# EasyEDA Pro project 3SE_24_Power_Rune.eprj, board 深大PCB参考 (continued)
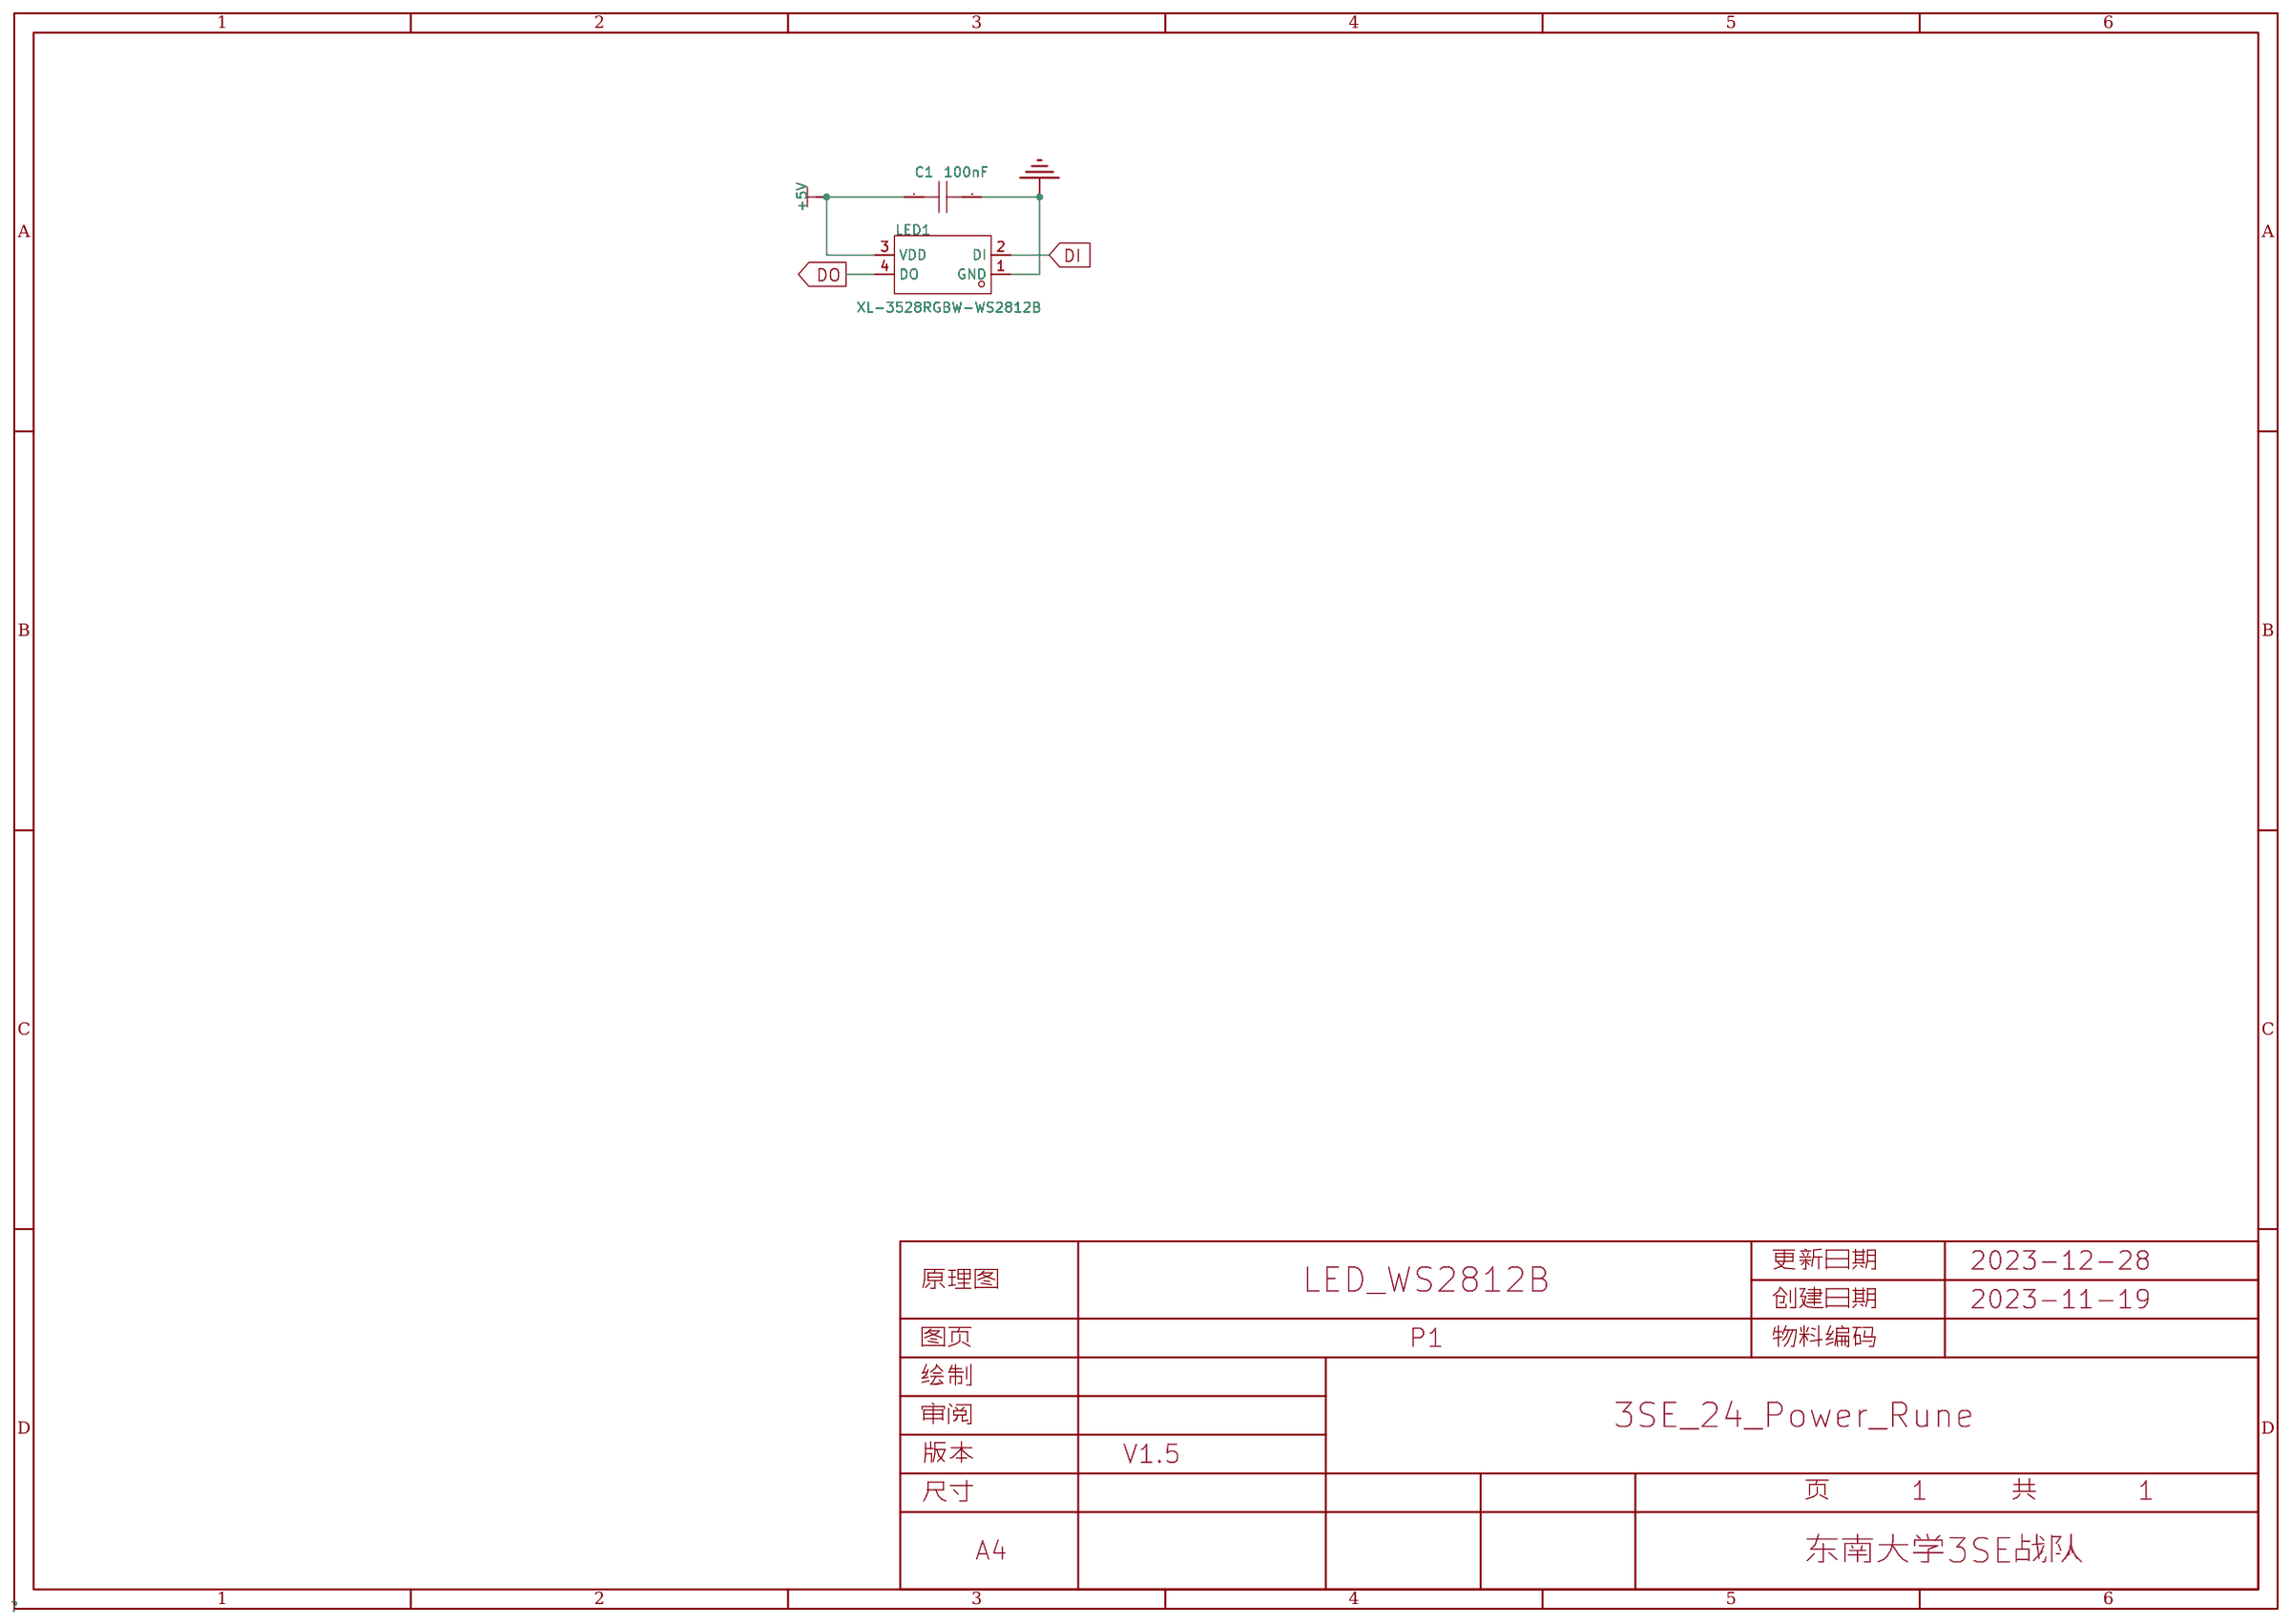
[diagram p0: schematic sheet]
## Routing (per net, layer and track width the routed paths; a pad name or vN(x,y) marks a point on that pad's centre or on a via; arc(x,y) is an arc through that point) (continued)
DIN1: length 17.4
  Bottom Layer w0.381: v1(19.43,252.35) 27.17,237.46 J1.1
DIN2: length 14.7
  Bottom Layer w0.381: J2.1 28.64,151.46 v1(30.61,137.54)
DIN3: length 7.7
  Bottom Layer w0.381: v2(40.39,194.69) 33.5,193.27 J3.1
I: length 13.6
  Top Layer w0.381: D356.2 143.8,117.85 156.07,117.34 D357.4
NETD1_2: length 8.2
  Top Layer w0.254: 30.62,248.61 30.62,249 arc(30.43,249.97) 29.88,250.79 27.59,253.08 arc(26.77,253.63) 25.79,253.82 D1.2
NETD2_2: length 20.5
  Top Layer w0.254: D3.4 36.29,250.2 arc(36.34,250.13) D2.2
NETD3_2: length 9.2
  Top Layer w0.254: D4.4 29.6,265.27 arc(28.78,265.82) 27.8,266.02 D3.2
NETD4_2: length 23
  Top Layer w0.254: 40.18,261.7 D4.2 arc(40.24,262.14) 39.99,262.51 D5.4
NETD5_2: length 10.6
  Top Layer w0.254: D6.4 31.19,279.05 arc(30.74,279.35) D5.2
NETD6_2: length 23.6
  Top Layer w0.254: D6.2 27.56,289.84 arc(27.32,290.2) D7.4
NETD7_2: length 11.4
  Top Layer w0.254: D7.2 33.9,292.05 arc(34.87,291.86) 35.7,291.31 D8.4
NETD8_2: length 25.1
  Top Layer w0.254: D8.2 47.44,286.99 arc(47.25,287.96) 46.7,288.79 D9.4
NETD9_2: length 10.1
  Top Layer w0.254: D10.4 37.58,305.8 arc(37,306.19) D9.2
NETD10_2: length 26
  Top Layer w0.254: D11.4 34.09,317.5 arc(34.29,316.53) 34.84,315.71 D10.2
NETD11_2: length 10.5
  Top Layer w0.254: D12.4 46.08,312.99 arc(45.89,313.96) 45.34,314.78 39.97,320.16
NETD12_2: length 35.5
  Top Layer w0.381: D12.2 51.73,312.07 36.47,342.72 D13.4
NETD13_2: length 7.2
  Top Layer w0.381: D14.4 43.07,335.4 arc(43.62,336.22) 43.81,337.19 43.81,338.88 arc(43.62,339.85) 43.07,340.67 42.02,341.72
NETD14_2: length 8.7
  Top Layer w0.381: D15.4 49.67,326.25 arc(50.23,327.08) 50.42,328.05 50.42,330.92 arc(50.23,331.89) 49.67,332.71 D14.2
NETD15_2: length 27
  Top Layer w0.381: D16.4 53.52,350.61 54.91,324.93 D15.2
NETD16_2: length 7.6
  Top Layer w0.508: 58.7,340.19 58.76,340.74 58.66,345.08 arc(58.65,345.11) 58.65,345.14 58.33,347.22 D16.2
NETD17_2: length 8.3
  Top Layer w0.381: 63.02,329.02 63.52,329.52 arc(64.07,330.34) 64.26,331.31 64.26,334.88 arc(64.07,335.85) 63.52,336.67 D17.2
NETD18_2: length 30.6
  Top Layer w0.254: D18.2 67.93,326.25 66.44,355.36 D19.4
NETD19_2: length 8.8
  Top Layer w0.381: D20.4 71.9,345.27 arc(72.45,346.09) 72.64,347.06 72.64,350.25 arc(72.45,351.22) 71.9,352.04 D19.2
NETD20_2: length 8.4
  Top Layer w0.381: D21.4 76.22,334.98 arc(76.77,335.8) 76.96,336.78 76.96,339.2 arc(76.77,340.17) 76.22,340.99 D20.2
NETD21_2: length 30.3
  Top Layer w0.381: D21.2 79.83,330.87 78.66,359.88 78.76,360.51
NETD22_2: length 8.2
  Top Layer w0.381: D22.2 83.73,356.85 arc(84.27,356.05) 84.45,355.09 84.45,351.12 arc(84.26,350.15) 83.72,349.34
NETD23_2: length 7.9
  Top Layer w0.381: D23.2 88.69,345.67 arc(89.24,344.84) 89.43,343.87 D24.4
NETD24_2: length 30.3
  Top Layer w0.381: 94,365.09 93.91,364.45 94.31,335.44 D24.2
NETD25_2: length 9.8
  Top Layer w0.381: D25.2 98.95,361.44 arc(99.5,360.62) 99.69,359.64 99.69,354.94 arc(99.5,353.96) 98.95,353.14 D26.4
NETD26_2: length 7.5
  Top Layer w0.381: D26.2 arc(103.49,348.45) 103.63,347.75 103.63,345.6 arc(103.44,344.63) 102.89,343.81 102.81,343.73 arc(102.31,342.98) D27.4
NETD27_2: length 30.1
  Top Layer w0.381: D27.2 107.01,339.25 107.65,368.1 107.75,368.73
NETD28_2: length 9.5
  Top Layer w0.381: D29.4 112.54,357.59 arc(113.09,358.41) 113.28,359.38 113.28,363.44 arc(113.09,364.41) 112.54,365.23 D28.2
NETD29_2: length 8.2
  Top Layer w0.381: D29.2 116.35,353.06 arc(116.9,352.23) 117.09,351.26 117.09,348.78 arc(116.9,347.81) 116.35,346.98 116.09,346.72 arc(115.72,346.17) D30.4
NETD30_2: length 30.5
  Top Layer w0.381: 120.37,342.05 120.47,342.68 118.42,371.82 D31.4
NETD31_2: length 8.6
  Top Layer w0.381: D32.4 123.72,361.65 arc(124.27,362.47) 124.46,363.45 124.46,366.76 arc(124.27,367.73) 123.72,368.55 123.29,368.98
NETD32_2: length 7.9
  Top Layer w0.254: D32.2 128.45,357.18 arc(128.79,356.49) 128.91,355.73 128.91,353.48 arc(128.71,352.51) 128.16,351.68 127.72,351.24 arc(127.49,350.89) D33.4
NETD33_2: length 29
  Top Layer w0.254: D34.4 130.44,375.17 132.32,347.72 D33.2
NETD34_2: length 8.7
  Top Layer w0.381: 134.64,364.58 134.64,364.61 arc(134.84,365.58) 135.39,366.4 135.78,366.79 arc(136.33,367.62) 136.53,368.59 136.53,369.58 ; D34.2 135.75,371.95 arc(136.33,370.83) 136.53,369.59
NETD35_2: length 8.4
  Top Layer w0.381: D36.4 138.2,353.68 arc(138.39,354.66) 138.94,355.48 139.67,356.2 arc(140.07,356.8) 140.21,357.5 140.21,358.82 arc(140.02,359.83) 139.49,360.7 arc(139.4,360.89) 139.42,361.1 ; 139.42,361.1 D35.2
NETD36_2: length 27.6
  Top Layer w0.381: D37.4 148.25,376.49 143.08,350.68 D36.2
NETD37_2: length 7
  Top Layer w0.381: D38.4 151.48,368.23 arc(152.03,369.06) 152.23,370.03 D37.2
NETD38_2: length 7.1
  Top Layer w0.381: D38.2 153.37,359.14 arc(153.18,358.17) 152.62,357.35 151.38,356.11 arc(151.11,355.93) 150.8,355.87
NETD39_2: length 27.8
  Top Layer w0.254: 154.51,351.27 154.83,351.92 164.95,377.01
NETD40_2: length 6.8
  Top Layer w0.381: D40.2 168.02,371.04 arc(167.83,370.07) 167.28,369.24 D41.4
NETD41_2: length 7.7
  Top Layer w0.381: D41.2 168.02,360.21 arc(167.83,359.24) 167.28,358.41 164.4,355.54 arc(164.37,355.52) D42.4
NETD42_2: length 28.5
  Top Layer w0.381: D42.2 167.95,351.17 177.62,376.67 D43.4
NETD43_2: length 7.7
  Top Layer w0.381: D43.2 181.23,370.37 arc(181.03,369.4) 180.48,368.57 178.39,366.47 arc(178.06,366.25) D44.4
NETD44_2: length 7.8
  Top Layer w0.381: D44.2 180.97,359.48 arc(180.78,358.51) 180.23,357.69 177.42,354.88
NETD45_2: length 29.7
  Top Layer w0.381: D46.4 191.72,376.92 181.03,350.53 D45.2
NETD46_2: length 7.5
  Top Layer w0.381: D47.4 194.58,369.12 arc(195.13,369.94) 195.32,370.91 D46.2
NETD47_2: length 7.8
  Top Layer w0.381: D47.2 195.2,359.35 arc(195,358.38) 194.45,357.56 D48.4
NETD48_2: length 29.3
  Top Layer w0.381: D49.4 204.8,377.09 195.51,350.66 D48.2
NETD49_2: length 7.4
  Top Layer w0.381: 208.4,372.75 208.4,370.91 arc(208.21,369.94) 207.66,369.11 D50.4
NETD50_2: length 7.4
  Top Layer w0.381: D50.2 208.41,359.19 arc(208.21,358.22) 207.66,357.39 D51.4
NETD51_2: length 29
  Top Layer w0.381: D51.2 209.22,351.01 218.64,377.09 D52.4
NETD52_2: length 6.3
  Top Layer w0.381: D53.4 221.5,369.75 arc(222.05,370.57) 222.25,371.55 D52.2
NETD53_2: length 8.8
  Top Layer w0.381: D54.4 221.89,358.45 arc(222.44,359.27) 222.63,360.24 D53.2
NETD54_2: length 30.3
  Top Layer w0.381: D55.4 238.71,375.06 222.43,351.04 D54.2
NETD55_2: length 7.5
  Top Layer w0.381: D55.2 arc(240.48,369.07) 240.09,368.49 237.22,365.62 arc(236.39,365.06) 235.42,364.87
NETD56_2: length 8.8
  Top Layer w0.381: D57.4 236.38,357.45 arc(236.88,358.2) D56.2
NETD57_2: length 32.1
  Top Layer w0.381: 232.89,346.8 233.38,347.22 252.93,371 D58.4
NETD58_2: length 8.3
  Top Layer w0.381: D59.4 250.1,360.5 arc(251.07,360.69) 251.9,361.24 254.1,363.44 arc(254.65,364.27) 254.84,365.24 D58.2
NETD59_2: length 9.4
  Top Layer w0.381: D60.4 245.27,349.07 arc(246.25,349.26) 247.07,349.81 250.03,352.77 arc(250.58,353.6) 250.78,354.57 D59.2
NETD60_2: length 31.6
  Top Layer w0.381: D61.4 265.89,366.81 246.18,343.76 D60.2
NETD61_2: length 8.7
  Top Layer w0.381: D61.2 267.79,361.3 arc(267.6,360.33) 267.05,359.51 264.21,356.67 arc(263.39,356.12) 262.42,355.93 D62.4
NETD62_2: length 9.6
  Top Layer w0.381: D63.4 257.97,344.24 arc(258.95,344.44) 259.77,344.99 262.6,347.82 arc(263.16,348.65) 263.35,349.62 D62.2
NETD63_2: length 32.8
  Top Layer w0.381: D63.2 258.88,338.93 280.09,362.2 D64.4
NETD64_2: length 9.3
  Top Layer w0.381: D65.4 275.47,351.35 arc(275.53,351.36) 275.59,351.38 arc(278.82,352.94) 281.62,355.17 arc(281.9,355.58) 281.99,356.07 281.99,356.88
NETD65_2: length 9.7
  Top Layer w0.381: D66.4 271.56,339.67 arc(272.53,339.86) 273.36,340.41 275.94,343 arc(276.49,343.82) 276.68,344.79 D65.2
NETD66_2: length 32.5
  Top Layer w0.381: 293.21,358.29 292.73,357.87 272.21,334.36 D66.2
NETD67_2: length 8.6
  Top Layer w0.381: D68.4 289.34,347.42 arc(290.31,347.61) 291.14,348.16 294.01,351.03 arc(294.48,351.73) D67.2
NETD68_2: length 10
  Top Layer w0.381: D69.4 284.48,335.31 arc(285.45,335.51) 286.27,336.06 288.47,338.25 arc(289.4,339.56) 289.86,341.1 D68.2
NETD69_2: length 32.2
  Top Layer w0.381: D69.2 285.27,330 305.38,353.47 D70.4
NETD70_2: length 8.4
  Top Layer w0.381: D70.2 307.29,347.84 arc(307.1,346.87) 306.55,346.04 304.22,343.72 arc(303.4,343.17) 302.42,342.97 D71.4
NETD71_2: length 9
  Top Layer w0.381: D71.2 303.1,336.92 arc(302.91,335.95) 302.36,335.12 299,331.77 arc(298.19,331.23) D72.4
NETD72_2: length 31
  Top Layer w0.381: D73.4 317.32,349.28 299.14,325.72 D72.2
NETD73_2: length 8.1
  Top Layer w0.381: D74.4 314.62,338.91 arc(315.59,339.1) 316.41,339.65 318.48,341.73 arc(319.04,342.55) 319.23,343.52 D73.2
NETD74_2: length 7.5
  Top Layer w0.381: D75.4 310.93,328.75 arc(311.9,328.94) 312.73,329.49 314.55,331.31 arc(315.1,332.14) 315.29,333.11 D74.2
NETD75_2: length 29.7
  Top Layer w0.381: D76.4 334.91,340.2 311.96,323.44 D75.2
NETD76_2: length 9.3
  Top Layer w0.381: D77.4 330.23,330.65 arc(331.21,330.84) 332.03,331.4 334.67,334.04 arc(334.83,334.28) D76.2
NETD77_2: length 10.5
  Top Layer w0.381: D78.4 320.91,320.11 arc(321.89,320.3) 322.71,320.85 326.63,324.78
NETD78_2: length 21
  Top Layer w0.381: 317.36,314.24 317.96,314.47 337.12,318.95 337.75,319.07
NETD79_2: length 12.8
  Top Layer w0.381: D80.4 331.51,309.84 arc(332.49,310.04) 333.31,310.59 336.12,313.39
NETD80_2: length 19.7
  Top Layer w0.381: D80.2 323.72,304.29 341.59,299.92 D81.4
NETD81_2: length 11.5
  Top Layer w0.381: 338.75,295.05 338.2,294.5 arc(337.37,293.94) 336.4,293.75 330.04,293.75 arc(329.07,293.94) 328.25,294.5 D82.4
NETD82_2: length 19.9
  Top Layer w0.381: 343.93,285.55 343.3,285.65 325.16,289.87 324.52,289.97
NETD83_2: length 10.4
  Top Layer w0.381: D84.4 332.57,280.53 arc(333.39,279.97) 334.36,279.78 338.41,279.78 arc(339.38,279.97) 340.21,280.53 D83.2
NETD84_2: length 19.9
  Top Layer w0.381: D85.4 345.97,271.04 328.33,277.04 D84.2
NETD85_2: length 10.7
  Top Layer w0.381: 343.12,266.17 343,266.05 arc(342.18,265.5) 341.21,265.3 336.14,265.3 arc(335.17,265.5) 334.34,266.05 333.33,267.06
NETD86_2: length 20.2
  Top Layer w0.381: D86.2 330.49,262.18 348.58,256.74 D87.4
NETD87_2: length 9.4
  Top Layer w0.381: D87.2 345.31,251.44 arc(344.49,250.89) 343.51,250.7 339.57,250.7 arc(338.6,250.89) 337.77,251.44 D88.4
NETD89_2: length 14
  Top Layer w0.381: D89.2 26.18,131.83 14.65,131.83 13.91,132.56 13.8,132.56
NETD90_2: length 24.2
  Top Layer w0.381: D90.2 10.41,127.87 30.91,127.87 33.34,125.45 D91.4
NETD91_2: length 13.8
  Top Layer w0.381: D91.2 27.89,118.55 arc(27.62,118.31) 27.31,118.11 arc(27.03,117.99) 26.75,117.89 arc(26.43,117.83) 26.1,117.81 17.32,117.81
NETD92_2: length 22.7
  Top Layer w0.381: D93.4 35.73,112.49 35.1,113.12 13.93,113.12 D92.2
NETD93_2: length 16.7
  Top Layer w0.381: 32.81,107.71 30.59,105.49 arc(29.77,104.94) 28.79,104.75 D94.4
NETD94_2: length 28.2
  Top Layer w0.381: D94.2 40.74,99.97 arc(41.32,99.86) 41.82,99.53
NETD95_2: length 10
  Top Layer w0.508: D96.4 28.96,95.16 35.62,94.55 arc(35.67,94.54) 35.72,94.55 37.79,94.81 D95.2
NETD96_2: length 10
  Top Layer w0.381: D97.4 23.28,89.76 arc(24.17,89.94) D96.2
NETD97_2: length 34.1
  Top Layer w0.381: 11.6,84.99 12.23,84.89 44.98,87.48 D98.4
NETD98_2: length 12
  Top Layer w0.381: D98.2 42.22,81.38 arc(41.4,80.83) 40.42,80.63 D99.4
NETD99_2: length 12.5
  Top Layer w0.381: D100.4 26.14,73.52 arc(27.11,73.71) 27.93,74.26 D99.2
NETD100_2: length 37.6
  Top Layer w0.381: 51.46,74.21 50.82,74.19 15.22,68.22 D100.2 14.79,68.21
NETD101_2: length 9.7
  Top Layer w0.381: D102.4 46.98,68.06 arc(47.95,68.25) 48.77,68.8 D101.2
NETD102_2: length 10.2
  Top Layer w0.381: 27.33,60.69 33.69,60.69 arc(34.67,60.89) 35.49,61.44 36.8,62.75
NETD103_2: length 10.8
  Top Layer w0.381: D103.2 23.04,53.69 arc(22.22,53.14) 21.25,52.95 D104.4
NETD104_2: length 44.5
  Top Layer w0.381: 54.54,61.64 53.91,61.52 12.93,47.65 D104.2
NETD105_2: length 11.3
  Top Layer w0.381: 43.36,51.54 47.43,51.54 arc(48.41,51.74) 49.23,52.29 D105.2
NETD106_2: length 11.3
  Top Layer w0.381: D106.2 38.05,42.19 arc(37.23,41.64) 36.26,41.45 32.19,41.45
NETD107_2: length 38.2
  Top Layer w0.381: D108.4 64.34,52.23 31.18,35.89 D107.2
NETD108_2: length 6.4
  Top Layer w0.381: D109.4 62.52,43.25 arc(63.49,43.45) 64.32,44 65.54,45.22 arc(66.06,46) D108.2
NETD109_2: length 8.2
  Top Layer w0.381: D110.4 58.46,32.46 arc(59.43,32.65) 60.25,33.2 62.45,35.4 arc(63,36.23) 63.2,37.2 D109.2
NETD110_2: length 30.3
  Top Layer w0.381: D110.2 59.61,27.14 77.47,50.02 D111.4
NETD111_2: length 8.2
  Top Layer w0.381: D112.4 74.46,39.06 arc(75.43,39.25) 76.25,39.81 78.63,42.18 arc(79.18,43.01) 79.38,43.98 D111.2
NETD112_2: length 7.5
  Top Layer w0.381: D113.4 71.54,28.77 arc(72.51,28.97) 73.33,29.52 75.03,31.21 arc(75.58,32.03) 75.77,33.01 D112.2
NETD113_2: length 31
  Top Layer w0.381: D114.4 91.39,46.52 72.7,23.46 D113.2
NETD114_2: length 8.5
  Top Layer w0.381: D115.4 92.55,38.73 arc(93.1,39.55) 93.3,40.52 D114.2
NETD115_2: length 7.7
  Top Layer w0.381: D116.4 85.89,24.84 arc(86.86,25.03) 87.68,25.58 89.12,27.02 arc(89.67,27.84) 89.87,28.82 D115.2
NETD116_2: length 34.1
  Top Layer w0.381: D117.4 107.42,44.55 86.16,19.52 D116.2
NETD117_2: length 9.1
  Top Layer w0.381: 109.33,39.24 109.33,38.52 arc(109.14,37.55) 108.59,36.73 D118.4
NETD118_2: length 8.4
  Top Layer w0.381: D119.4 100.75,21.41 arc(101.72,21.6) 102.54,22.15 104.74,24.35 arc(105.29,25.18) 105.49,26.15 D118.2
NETD119_2: length 33
  Top Layer w0.381: D120.4 123.01,39.53 101.65,16.1 D119.2
NETD120_2: length 9.1
  Top Layer w0.381: D120.2 124.92,33.51 arc(124.73,32.54) 124.17,31.72 121.59,29.14 arc(120.77,28.59) 119.8,28.39 D121.4
NETD121_2: length 8.1
  Top Layer w0.381: D121.2 120.47,22.47 arc(120.28,21.49) 119.73,20.67 118.04,18.98 arc(117.21,18.43) 116.24,18.23 D122.4
NETD122_2: length 31.7
  Top Layer w0.381: D122.2 116.64,12.92 135.58,36.74 D123.4
NETD123_2: length 8
  Top Layer w0.381: D123.2 137.49,31.38 arc(137.3,30.41) 136.75,29.58 D124.4
NETD124_2: length 7.9
  Top Layer w0.381: D124.2 arc(133.75,18.7) 133.23,17.92 130.04,14.73 arc(129.43,14.31) D125.4
NETD125_2: length 32.2
  Top Layer w0.381: D126.4 148.79,33.82 130.61,8.86 D125.2
NETD126_2: length 8
  Top Layer w0.381: D127.4 146.47,23.44 arc(147.44,23.63) 148.26,24.18 149.37,25.29 arc(150.23,26.5) 150.66,27.92 D126.2
NETD127_2: length 7.5
  Top Layer w0.381: D127.2 147.02,17.28 arc(146.82,16.31) 146.27,15.49 D128.4
NETD128_2: length 31.6
  Top Layer w0.381: D128.2 144.58,6.57 146.33,9.69 arc(146.33,9.7) 146.34,9.71 158.06,33.77 D129.4
NETD129_2: length 7.5
  Top Layer w0.381: D129.2 161.67,26.5 arc(161.48,25.52) 160.93,24.7 D130.4
NETD130_2: length 8.8
  Top Layer w0.381: D130.2 162.42,16.03 arc(162.23,15.06) 161.68,14.23 159.41,11.97 arc(158.72,11.5) D131.4
NETD131_2: length 30.4
  Top Layer w0.381: D131.2 161.51,7 172.81,33.89 D132.4
NETD132_2: length 7.8
  Top Layer w0.381: D132.2 176.42,27.06 arc(176.22,26.09) 175.67,25.27 D133.4
NETD133_2: length 8.3
  Top Layer w0.381: D133.2 176.6,16.5 arc(176.41,15.53) 175.86,14.71 D134.4
NETD134_2: length 30.1
  Top Layer w0.381: D135.4 186.58,33.89 176.1,7 D134.2
NETD135_2: length 7.7
  Top Layer w0.381: D136.4 189.45,24.86 arc(190,25.69) 190.19,26.66 D135.2
NETD136_2: length 8.1
  Top Layer w0.381: D136.2 190.78,16.1 arc(190.59,15.13) 190.04,14.3 D137.4
NETD137_2: length 30.2
  Top Layer w0.381: D137.2 190.68,7 201.35,33.89 D138.4
NETD138_2: length 7.9
  Top Layer w0.381: D139.4 204.22,25.45 arc(204.77,26.28) 204.96,27.25 D138.2
NETD139_2: length 7.9
  Top Layer w0.381: D139.2 204.96,15.69 arc(204.77,14.72) 204.22,13.9 D140.4
NETD140_2: length 30.4
  Top Layer w0.381: D141.4 213.81,34.89 205.27,7 D140.2
NETD141_2: length 7.8
  Top Layer w0.381: 216.77,23.57 216.98,24.18 217.78,28.49 arc(217.78,28.51) 217.79,28.54 217.91,30.64 D141.2
NETD142_2: length 8
  Top Layer w0.381: D143.4 219.01,12.26 220.56,16.36 arc(220.57,16.42) 220.58,16.48 220.66,18.72 D142.2
NETD143_2: length 30.9
  Top Layer w0.381: D144.4 227.42,37.34 223.11,8 D143.2
NETD144_2: length 7.9
  Top Layer w0.381: D145.4 231.03,26.48 231.5,30.93 arc(231.5,30.95) 231.5,30.97 231.52,33.08 D144.2
NETD145_2: length 7.7
  Top Layer w0.381: D145.2 234.72,21.02 234.68,18.9 arc(234.68,18.87) 234.67,18.84 233.87,14.67 D146.4
NETD146_2: length 31.1
  Top Layer w0.381: D146.2 237.97,10.42 241.02,40.13 D147.4
NETD147_2: length 8.1
  Top Layer w0.381: D147.2 245.12,35.88 245.09,29.02 244.88,28.42
NETD148_2: length 8
  Top Layer w0.381: D148.2 248.78,23.56 248.65,21.43 arc(248.65,21.41) 248.64,21.39 247.91,16.92 D149.4
NETD149_2: length 31.1
  Top Layer w0.381: 251.8,12.07 252.01,12.67 254.62,42.42 254.83,43.02
NETD150_2: length 8.2
  Top Layer w0.381: D151.4 258.19,31.48 arc(258.74,32.3) 258.93,33.28 D150.2
NETD151_2: length 7.9
  Top Layer w0.381: D151.2 261.56,26.1 261.56,19.5 D152.4
NETD152_2: length 31.2
  Top Layer w0.381: D153.4 268.23,45.08 265.66,15.24 D152.2
NETD153_2: length 7.8
  Top Layer w0.381: D154.4 273.2,34.35 272.33,40.83 D153.2
NETD154_2: length 8
  Top Layer w0.381: D155.4 276.35,22.85 arc(276.9,23.67) 277.1,24.64 D154.2
NETD155_2: length 30.2
  Top Layer w0.381: D155.2 279.88,18.42 281.1,47.33 D156.4
NETD156_2: length 8.4
  Top Layer w0.381: 286.71,36.22 286.81,36.85 286.26,41.68 arc(286.26,41.69) 286.26,41.7 285.88,43.86 D156.2
NETD157_2: length 7.1
  Top Layer w0.381: D158.4 292.51,30.67 arc(292.31,31.65) 291.76,32.47 D157.2
NETD158_2: length 28.4
  Top Layer w0.381: 297.28,22.52 297.38,23.15 295.96,50.26 D159.4
NETD159_2: length 7.7
  Top Layer w0.381: D160.4 301.46,45.91 arc(301.3,46.72) 300.84,47.41
NETD160_2: length 7.7
  Top Layer w0.381: 306.86,28.79 306.86,34.86 arc(306.7,35.67) D160.2
NETD161_2: length 28.6
  Top Layer w0.381: D161.2 311.73,25.94 309.2,53.18 D162.4
NETD162_2: length 11.2
  Top Layer w0.381: D163.4 319.9,47.06 arc(319.7,48.03) 319.15,48.85 D162.2
NETD163_2: length 10.5
  Top Layer w0.381: D163.2 330.2,38.92 arc(330.75,38.1) 330.95,37.13 D164.4
NETD164_2: length 37.7
  Top Layer w0.381: D164.2 336.59,34.83 315.94,64.87 D165.4
NETD165_2: length 11.6
  Top Layer w0.381: D165.2 322.32,66.78 arc(323.29,66.58) 324.11,66.03 327.73,62.41 arc(328.28,61.59) 328.48,60.62 D166.4
NETD166_2: length 10.7
  Top Layer w0.381: D167.4 341.18,53.25 arc(340.98,54.22) 340.43,55.05 335.37,60.11 arc(334.84,60.46) 334.21,60.59
NETD167_2: length 10.6
  Top Layer w0.381: 346.91,54.4 347.39,54.4 arc(348.13,54.25) 348.76,53.83 351.43,51.16 arc(352.7,49.31) 353.23,47.12 D168.4
NETD168_2: length 49.2
  Top Layer w0.381: D169.4 322.04,79.76 358.55,48.69 D168.2
NETD169_2: length 11.9
  Top Layer w0.381: D169.2 328.05,81.67 arc(329.02,81.47) 329.85,80.92 D170.4
NETD170_2: length 13.1
  Top Layer w0.381: D171.4 351.08,67.35 arc(350.89,68.32) 350.34,69.14 344.38,75.1 arc(343.56,75.65) 342.59,75.84 D170.2
NETD171_2: length 40.5
  Top Layer w0.381: 325.92,94.75 326.34,94.27 356.4,69.09 D171.2
NETD172_2: length 10.3
  Top Layer w0.381: D172.2 331.78,96.17 arc(332.75,95.98) 333.58,95.43 338.74,90.27 arc(338.99,89.9) 339.07,89.46
NETD173_2: length 9.7
  Top Layer w0.381: D173.2 345.33,90.88 arc(346.3,90.69) 347.12,90.14 D174.4
NETD174_2: length 35.3
  Top Layer w0.381: 357.96,86.46 357.54,86.95 331.24,108.46 D175.4
NETD175_2: length 16.9
  Top Layer w0.381: 336.55,110.36 339.64,110.36 arc(340.61,110.17) 341.44,109.62 D176.4
NETD176_2: length 29.4
  Top Layer w0.381: D176.2 335.74,122.47 arc(335.35,123.06) D177.4
NETD177_2: length 11.4
  Top Layer w0.381: D177.2 342.09,125.19 arc(343.06,125) 343.88,124.45 D178.4
NETD178_2: length 24.4
  Top Layer w0.381: D179.4 340.16,136.38 arc(340.35,135.41) 340.9,134.58 355.47,120.02
NETD179_2: length 8.4
  Top Layer w0.381: D179.2 346.98,139.65 arc(347.95,139.46) 348.77,138.91 350.85,136.83 arc(351.4,136.01) 351.59,135.04 D180.4
NETD181_2: length 13.9
  Top Layer w0.381: 43.69,189.83 43.69,178.18 45.12,176.75 45.33,176.75
NETD182_2: length 17.7
  Top Layer w0.381: D182.2 40.51,172.49 40.51,155.42 D183.4
NETD183_2: length 11.2
  Top Layer w0.381: D184.4 49.45,143.93 arc(49.26,144.9) 48.71,145.73 45.77,148.67 arc(45.22,149.49) 45.03,150.46 45.03,151.48
NETD184_2: length 14.1
  Top Layer w0.381: 60.5,126.77 D185.4 ; 54.33,138.55 54.33,138.24 arc(54.52,137.27) 55.07,136.45 57.17,134.34 arc(59.42,131.03) 60.27,127.11 arc(60.33,126.91) 60.5,126.77
NETD185_2: length 16.4
  Top Layer w0.381: D185.2 58.75,121.39 69.85,111.15 70.48,111.23
NETD186_2: length 13.7
  Top Layer w0.381: 68.46,105.68 69.09,105.76 79.92,99.62 80.54,99.78
NETD187_2: length 20
  Top Layer w0.381: D187.2 79.03,93.41 79.27,89.94 79.28,89.8 79.39,89.69 82.98,86.42 83.11,86.4 93.05,85.52 D188.4
NETD188_2: length 15.8
  Top Layer w0.381: 107.36,75.16 107.59,75.16 107.17,74.92 93.68,80.11 D188.2
NETD189_2: length 15.7
  Top Layer w0.381: D190.4 122.47,66.15 108.44,69.61 D189.2
NETD190_2: length 18.5
  Top Layer w0.381: D190.2 140.82,60.68 arc(141.56,60.54) 142.19,60.12
NETD191_2: length 16.5
  Top Layer w0.381: D191.2 159.41,54.44 arc(159.87,54.53) D192.4
NETD192_2: length 20.8
  Top Layer w0.381: D192.2 162.99,49.85 182.44,51.55 D193.4
NETD193_2: length 11.8
  Top Layer w0.381: D193.2 186.36,47.77 196.17,51.67 D194.4
NETD194_2: length 11.2
  Top Layer w0.381: D194.2 200.32,48.15 208.43,53.82 D195.4
NETD195_2: length 9
  Top Layer w0.381: D196.4 220.96,50.12 213.2,49.74 212.79,50.24
NETD196_2: length 19.9
  Top Layer w0.381: 242.15,64.78 242.11,64.14 225.92,54.87 225.46,54.43
NETD197_2: length 15.7
  Top Layer w0.381: D198.4 257.68,72.43 247.26,62.39 D197.2
NETD198_2: length 15.7
  Top Layer w0.381: D198.2 263.02,71.34 272.15,82.52 D199.4
NETD199_2: length 21.1
  Top Layer w0.381: D200.4 285.85,98.61 285.7,98.6 285.59,98.49 281.18,93.79 281.15,93.73 277.23,84.1 277.23,83.99 277.24,83.95 D199.2
NETD200_2: length 14.5
  Top Layer w0.381: D200.2 292.66,98.31 298.31,110.27 D201.4
NETD201_2: length 15.4
  Top Layer w0.381: D202.4 306.77,125.03 303.67,111.22 D201.2
NETD202_2: length 13.3
  Top Layer w0.381: 312.31,126.1 311.97,126.64 314.26,138.45 313.85,138.94
NETD203_2: length 15.6
  Top Layer w0.381: D204.4 319.91,155.05 319.22,140.7 D203.2
NETD204_2: length 15.7
  Top Layer w0.381: 322.99,172.7 323.5,172.32 324.54,157.9 D204.2
NETD205_2: length 16
  Top Layer w0.381: 324.57,190.5 325.13,190.19 327.75,175.74 D205.2
NETD206_2: length 15.5
  Top Layer w0.381: D207.4 324.09,207.54 328.92,194.11 D206.2
NETD207_2: length 18
  Top Layer w0.381: D208.4 327.45,228.71 328.46,212.04 327.95,211.66
NETD208_2: length 12.4
  Top Layer w0.381: D209.4 315.91,241.79 320.7,238.69 arc(320.79,238.61) 320.85,238.51 ; 320.85,238.51 322.7,233.67 D208.2
NETD209_2: length 15.7
  Top Layer w0.381: D210.4 308.66,257.88 317.98,246.83 D209.2
NETD210_2: length 15.7
  Top Layer w0.381: D210.2 310.09,263.14 299.46,272.94 D211.4
NETD211_2: length 12.1
  Top Layer w0.381: D211.2 300.21,278.33 291.48,284.71 290.87,284.55
NETD212_2: length 21.6
  Top Layer w0.381: D212.2 292.37,290.92 288.88,296.56 288.86,296.6 288.81,296.66 286.62,298.24 286.51,298.25 275.78,299.01 D213.4
NETD213_2: length 15.7
  Top Layer w0.381: 275.77,304.66 275.17,304.43 261.68,309.62 D214.4
NETD214_2: length 15.7
  Top Layer w0.381: D214.2 260.4,314.92 246.36,318.38 245.85,318.01
NETD215_2: length 15.7
  Top Layer w0.381: D216.4 230.07,325.15 244.43,323.47 D215.2
NETD216_2: length 15.7
  Top Layer w0.381: D216.2 227.51,329.96 213.05,329.83 212.64,329.33
NETD217_2: length 11.5
  Top Layer w0.381: D218.4 199.96,331.87 209.91,334.27 210.32,334.76
NETD218_2: length 11.5
  Top Layer w0.381: D218.2 196.28,335.89 186.36,333.26 D219.4
NETD219_2: length 19.5
  Top Layer w0.381: D219.2 182.44,337.04 165.23,331.22 D220.4
NETD220_2: length 14
  Top Layer w0.381: D221.4 147.72,335.32 160.46,335.29 160.87,334.8
NETD221_2: length 20.7
  Top Layer w0.381: D222.4 126.53,319.92 142.76,330.58 D221.2
NETD222_2: length 14.3
  Top Layer w0.381: 111.71,312.34 111.67,312.98 121.38,321.67 D222.2
NETD223_2: length 15.6
  Top Layer w0.381: 97.45,302.31 97.33,302.94 106.34,314.07 D223.2
NETD224_2: length 23.1
  Top Layer w0.381: D225.4 81.83,286.88 82.3,286.88 82.47,287.05 84.48,287.05 91.94,294.52 91.94,303.83 D224.2
NETD225_2: length 12.9
  Top Layer w0.381: D226.4 72.66,276.32 76.02,287.39 D225.2
NETD226_2: length 13.8
  Top Layer w0.381: D227.4 62.8,263.7 67.3,275.37 67.03,275.95
NETD227_2: length 18.8
  Top Layer w0.381: D227.2 57.6,262.08 54.68,244.84 D228.4
NETD228_2: length 14.4
  Top Layer w0.381: 49.31,243.08 49.72,242.59 48.93,229.48 D229.4
NETD229_2: length 15.7
  Top Layer w0.381: D230.4 45.33,212.21 44.29,226.63 D229.2
NETD230_2: length 25
  Top Layer w0.381: 40.57,209.17 41.09,208.79 48.42,203.09 59.8,194.24 D231.4
NETD231_2: length 14.5
  Top Layer w0.381: D232.4 58.75,177.37 56.02,190.32 D231.2
NETD232_2: length 15
  Top Layer w0.381: 55.05,158.53 55.2,159.15 54.44,172.8 D232.2
NETD233_2: length 14.7
  Top Layer w0.254: D233.2 60.03,154.15 67.64,143.34 D234.4
NETD234_2: length 15.8
  Top Layer w0.254: D235.4 75.59,127.56 65.95,138.15 D234.2